# EasyEDA Pro project ProPrj_Avaota A1 八核 AIoT 开发板_2024-05-03.epro, board PCB7 (continued)
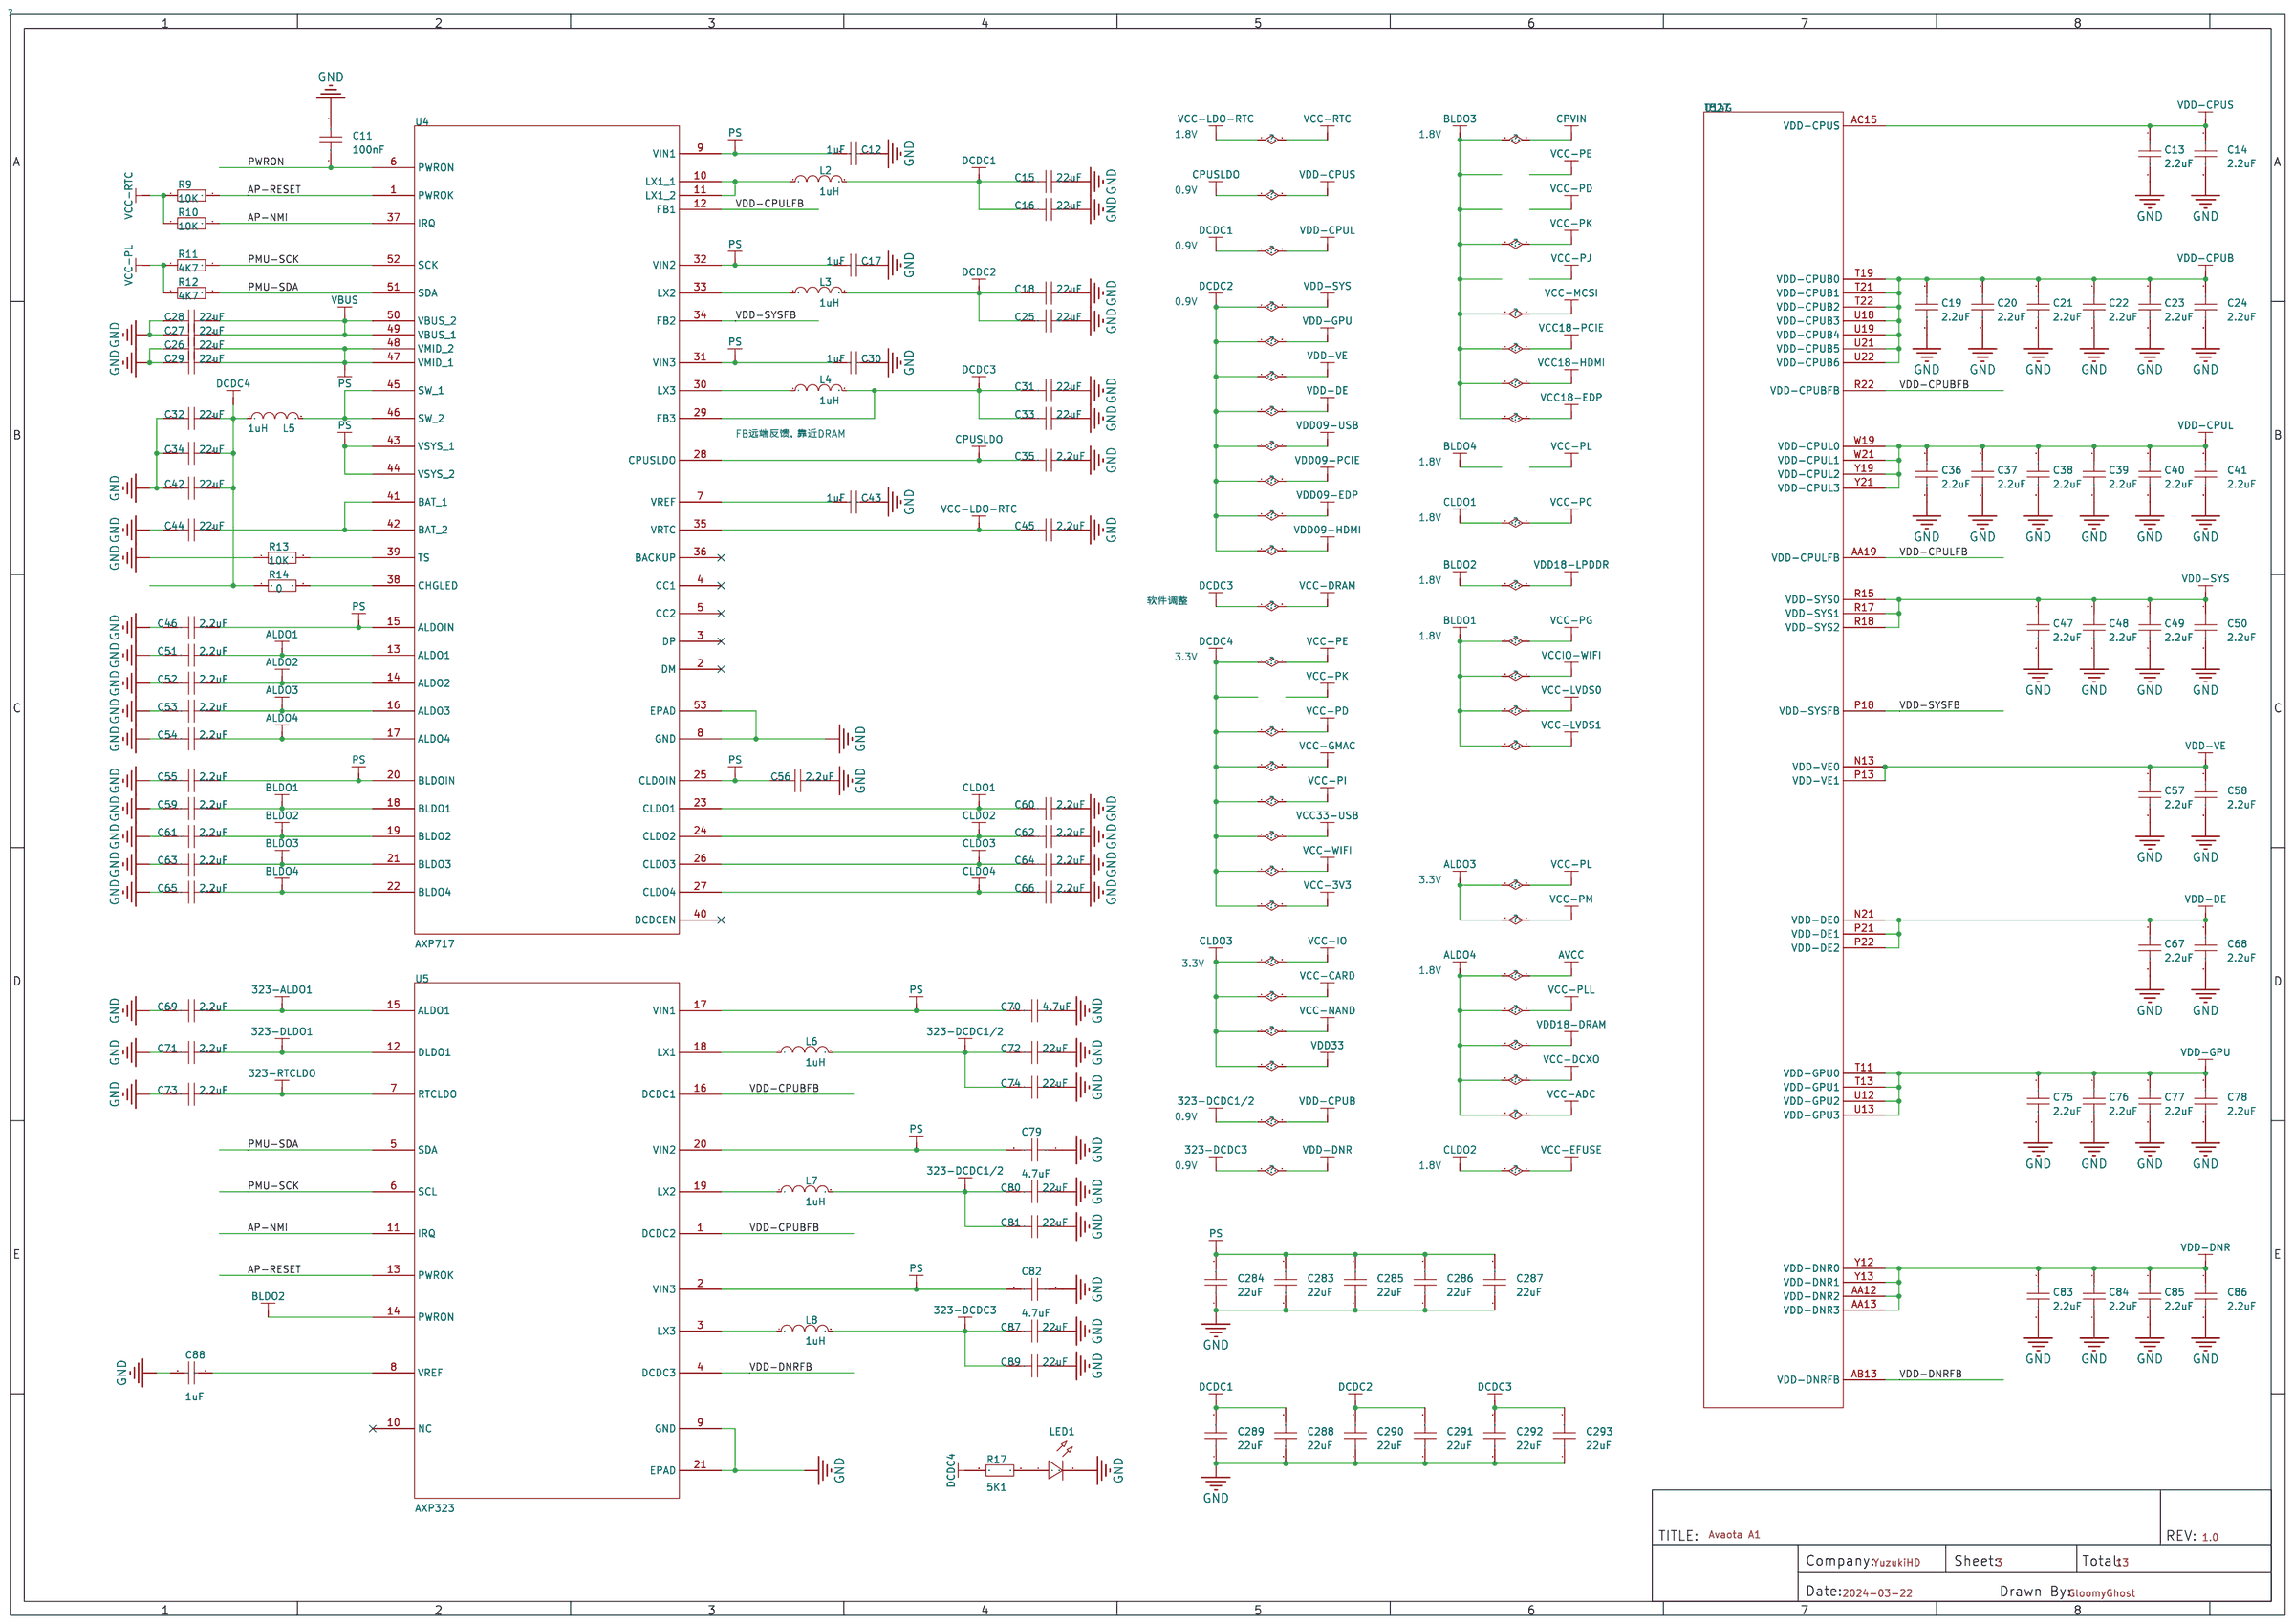
[diagram p0: POWER]
## Routing (per net, layer and track width the routed paths; a pad name or vN(x,y) marks a point on that pad's centre or on a via; arc(x,y) is an arc through that point) (continued)
  Inner1 w0.076: 37.95,17.58 37.9,17.58 37.88,17.55 37.62,17.55 37.59,17.58 37.49,17.58 ; 38.3,9.14 38.35,9.19 38.66,9.19 38.71,9.14
  Bottom Layer w0.203: v1(32.9,11.36) 32.8,11.45 C15.1 ; v1(39.3,12.14) 39.03,11.87 C16.1
  Bottom Layer w0.254: C26.1 35.31,16.14 v1(35.31,16.05) ; v1(30.4,8.47) 30.55,8.32 30.55,7.95 ; 21.31,16.16 21.47,16 C46.2 ; 21.31,16.16 21.31,15.95 20.57,15.95 20.55,15.92 ; 21.31,16.16 21.31,16.28 v1(21.03,16.56) ; 33.09,9.47 33.09,9.01 v1(32.92,8.84) ; 29.92,16.59 30.39,16.59 v1(30.55,16.75) 30.82,17.02 31.52,17.02 31.92,16.62 C43.1 ; C23.1 30.72,15.95 v1(30.28,15.95) 29.9,15.57 29.79,15.57 ; v1(12.67,16.64) 12.62,16.59 12.62,16.36 12.84,16.14 C10.1 ; v1(15.21,17.37) 15.21,17.06 C17.2 15.15,16.99 14.78,16.99 14.71,16.92 C9.1 C11.1 ; v1(32.68,19.95) 32.59,20.04 32.59,20.5 32.61,20.52 ; v1(32.28,5.23) 32.56,5.51 33.61,5.51 ; v1(38.61,17.86) 38.48,17.98 37.8,17.98 37.54,17.73 37.03,17.73 ; v1(40.14,18.52) 39.83,18.82 39.83,19.13 ; v1(32.92,13.94) 33.25,14.27 33.25,14.33 ; C21.1 37.71,15.79 v1(37.8,15.88) ; v1(34.67,15.47) 34.77,15.57 35.13,15.57 ; C42.1 38.01,5.52 v1(37.87,5.38) ; 34.9,10.45 34.46,10.01 v1(34.46,9.91) ; v1(36.9,9.36) 37.04,9.23 37.04,8.81 ; v1(37.77,13.94) 37.52,13.94 37.11,13.53 37.06,13.53 ; C41.1 32.75,18.28 v1(32.94,18.47) ; v1(36.65,5.41) 36.63,5.41 36.53,5.31 36.53,4.78 ; v1(39.31,15.32) 38.94,15.69 38.94,15.7
  vias: v1(40.36,11.12)
VCC-DRAM: length 75.8
  Top Layer w0.115: 28.51,9.78 28.51,9.9 28.5,9.91
  Top Layer w0.203: 30.92,14.94 30.85,15.01 30.28,15.01 29.51,15.77 29.51,16.29
  Top Layer w0.254: v1(38.5,18.53) 38.49,18.53 38.18,18.84 38.12,18.84 ; 34.12,7.79 34.12,7.86 v1(34.59,8.33) ; 32.52,13.64 32.28,13.64 v1(32.13,13.79) ; 36.52,16.24 36.16,16.24 v1(35.97,16.05) ; 34.12,6.49 34.12,6.43 34.42,6.12 35.03,6.12 35.28,6.38 v1(35.28,6.81) 35.56,6.53 v1(36.07,6.53) 36.1,6.49 36.52,6.49 ; v1(35,9.88) 35,9.86 34.65,9.5 34.53,9.5 34.12,9.09 ; 40.11,13.93 v1(40.06,13.87) 39.94,13.87 39.72,13.64 ; 40.11,13.93 40.46,14.27 C34.2 C36.2 ; 40.11,13.93 v1(40.11,14.65) ; v1(33.73,17.88) 33.78,17.88 34.12,17.54 ; 32.52,11.69 32.41,11.69 v1(32.12,11.4) ; v1(35.97,18.92) 36.05,18.84 36.52,18.84 ; 36.52,17.54 36.03,17.54 v1(35.94,17.63) ; 36.52,14.94 36.2,14.94 v1(36.05,15.09) ; C28.1 40.89,10.85 v1(40.87,10.87) ; 38.12,11.69 38.26,11.84 v1(38.26,12.23) ; v1(32.13,9.4) 32.21,9.4 32.52,9.09 ; 30.92,13.64 30.55,13.64 30.48,13.72 ; 34.12,18.84 34.12,18.89 v1(33.76,19.25) ; v1(37.64,13.16) 38.12,13.63 38.12,13.64 ; v1(29.92,7.39) 29.92,7.49 30.23,7.79 30.92,7.79 ; C38.2 C39.2 40.61,6.32 40.26,6.67 40.26,7.39 v1(40.16,7.49) 39.86,7.79 39.72,7.79 ; v1(35.53,9.88) 35.53,10.14 35.28,10.39 34.12,10.39 ; 34.12,14.94 33.8,15.27 33.76,15.27 33.76,15.27 v1(33.75,15.27) ; v1(33.26,19.95) 33.27,19.93 33.27,19.84 33.29,19.82 33.29,19.52 33.32,19.49 ; v1(40.11,14.65) 40.13,14.67 ; v1(40.11,14.65) 40.01,14.65 39.72,14.94 ; v1(36.02,7.42) 36.14,7.42 36.52,7.79 ; v1(31.65,5.26) 32.11,5.72 32.11,5.94 32.52,6.36 32.52,6.49 ; 36.52,9.09 36.07,9.54 v1(36.07,9.93) 36.07,9.93 36.52,10.38 36.52,10.39 ; 29.51,16.29 29.16,16.29 v1(28.93,16.05) ; R2.2 28.45,9.79 28.45,9.98 28.72,10.26 29.38,10.26 v1(29.46,10.34) 29.52,10.39 30.92,10.39 ; 32.52,16.24 32.81,16.54 32.94,16.54 32.94,16.49 ; v1(39.39,10.72) 39.72,10.39 ; 37.32,5.84 37.32,5.4 v1(37.28,5.35) ; 38.12,9.09 38.31,9.09 v1(38.55,8.85) ; 30.92,11.69 30.62,11.69 v1(30.56,11.63) ; 39.72,17.54 39.9,17.54 v1(40.16,17.81) 40.79,17.81 C33.2 C31.2 ; C37.2 C35.2 40.11,11.94 v1(39.98,12.07) 39.72,11.8 39.72,11.69 ; v1(34.7,5.21) 34.62,5.28 33.88,5.28 33.32,5.84 ; 38.12,6.49 37.72,6.1 v1(37.72,6.1) ; 34.12,16.24 34.31,16.05 v1(34.62,16.05) ; v1(38.46,15.93) 38.14,16.24 38.12,16.24 ; 30.92,17.54 30.59,17.54 v1(30.53,17.6) ; 37.32,19.49 37.32,19.89 v1(37.44,20.02) 38,20.57 40.59,20.57 C30.2 ; v1(32.13,19.23) 32.13,19.23 32.52,18.84
  Bottom Layer w0.152: v1(13.69,15.15) 13.69,16.7 R3.2
  Bottom Layer w0.203: v1(38.26,12.23) 38.46,12.04 C16.2 ; C14.2 31.7,5.31 v1(31.65,5.26) ; C15.2 32.23,11.51 v1(32.12,11.4) ; v1(35,9.88) v1(35.53,9.88)
  Bottom Layer w0.254: 33.11,20.52 33.11,20.09 v1(33.26,19.95) ; v1(14.69,11.65) v1(14.69,12.15) ; v1(14.69,12.15) 14.61,12.07 C6.2 ; v1(14.69,12.15) v1(14.69,12.65) ; 29.92,17.09 30.17,17.09 30.53,17.45 v1(30.53,17.6) ; 36.53,17.73 36.04,17.73 v1(35.94,17.63) ; 37.03,4.78 37.28,5.02 v1(37.28,5.35) ; v1(40.87,10.87) 40.72,10.72 v1(39.39,10.72) ; C10.2 13.18,15.16 v1(13.19,15.15) ; 38.94,16.2 38.81,16.2 38.53,15.93 v1(38.46,15.93) ; v1(38.55,8.85) 38.51,8.81 37.54,8.81 ; 36.7,18.84 36.05,18.84 v1(35.97,18.92) ; v1(12.69,15.15) v1(12.69,15.65) ; v1(12.69,15.15) v1(13.19,15.15) ; v1(12.69,15.15) v1(12.69,14.65) ; C42.2 v1(37.72,6.1) ; v1(36.07,6.53) 36.07,7.37 v1(36.02,7.42) ; v1(14.69,14.15) 14.69,14.62 ; 14.69,14.62 C40.2 ; 14.69,14.62 v1(14.69,15.15) ; v1(14.69,12.65) 14.64,12.6 C7.2 ; v1(14.69,12.65) v1(14.69,13.15) 14.68,13.16 C8.2 ; v1(13.19,15.15) v1(13.69,15.15) v1(14.19,15.15) ; 29.29,15.57 29.29,15.69 v1(28.93,16.05) ; v1(37.64,13.16) 37.18,13.16 37.06,13.03 ; C43.2 32.92,16.51 v1(32.95,16.49) ; v1(36.07,9.93) 35.55,10.45 35.4,10.45 35.4,10.01 v1(35.53,9.88) ; v1(33.76,19.25) 33.86,19.35 33.86,19.84 ; v1(14.19,15.15) v1(14.69,15.15) ; v1(14.19,15.15) 14.19,15.55 C11.2 ; v1(14.69,15.15) 14.69,15.55 C9.2 ; v1(36.05,15.09) 35.63,15.51 35.63,15.72 v1(35.97,16.05) ; C41.2 v1(33.73,17.88) ; v1(29.92,7.39) 29.96,7.43 C27.1 ; 39.33,19.13 38.74,18.54 38.51,18.54 v1(38.5,18.53) ; 34.11,5.51 34.39,5.51 v1(34.7,5.21)
  vias: v1(30.48,13.72)
VDD18-DRAM: length 7.5
  Top Layer w0.254: 15.19,16.15 U1.AD25
  Bottom Layer w0.254: 20.55,15.42 21.51,15.42 C46.1 ; 20.55,15.42 20.57,15.45 ; 20.55,15.42 19.53,15.42 19.38,15.57 16.43,15.57 15.84,16.15 v1(15.19,16.15) C17.1
VDD18-LPDDR: length 24.9
  Top Layer w0.102: 37.32,9.74 v1(37.67,10.09)
  Top Layer w0.254: 39.72,9.09 v1(40.03,9.4) 40.05,9.4 40.75,8.7 C19.1 C20.2 ; 37.32,15.59 37.09,15.82 36.91,15.82 36.9,15.83 v1(36.89,15.83) ; v1(31.32,16.59) 30.97,16.24 30.92,16.24 ; v1(33.73,9.47) 33.59,9.47 33.32,9.74 ; 33.32,15.59 33.32,15.62 33.72,16.02 v1(33.75,16.02) ; 39.72,16.24 v1(40.26,16.24) 40.42,16.08 C24.2
  Top Layer w0.305: 30.92,9.09 31.25,9.42 31.29,9.42 v1(31.29,9.43)
  Bottom Layer w0.203: v1(33.75,16.02) 33.27,15.55 C25.2 32,14.86 31.32,15.54 C23.2
  Bottom Layer w0.254: C26.2 33.83,16.02 v1(33.75,16.02) ; v1(36.89,15.83) 37.13,15.59 C21.2 ; v1(40.26,16.24) 40.3,16.24 ; C23.2 v1(31.32,16.59) ; v1(31.29,9.43) 31.29,9.96 31.57,10.24 32.33,10.24 32.72,10.62 33.22,10.62 33.5,10.34 33.5,9.71 v1(33.73,9.47) 36.32,9.47 36.5,9.65 36.5,10.24 36.73,10.46 37.29,10.46 v1(37.67,10.09) 37.67,10.09 38.1,10.52 38.73,10.52 38.94,10.31 38.94,9.86 39.34,9.45 39.98,9.45 v1(40.03,9.4)
SAA0: length 16.5
  Top Layer w0.076: v1(18.26,18.67) 18.26,18.72 17.94,19.04 17.94,19.4 U1.AJ33
  Top Layer w0.115: 31.72,14.94 31.42,14.64 30.64,14.64 30.53,14.76 29.8,14.76 28.86,15.7 28.7,15.7 v1(28.35,16.05)
  Inner5 w0.115: v1(18.26,18.67) 18.33,18.75 20.7,18.75 21.69,17.75 25.86,17.75 26.64,16.97 26.93,16.97 27.84,16.05 v1(28.35,16.05)
SAA1: length 17.3
  Top Layer w0.076: U1.AJ32 17.69,19.04 17.94,18.79 17.94,18.36 v1(18.16,18.14)
  Top Layer w0.115: v1(28.73,15.32) 28.73,14.99 29.79,13.92 30.15,13.92 30.37,14.14 30.67,14.14 30.82,14 31.05,14 31.35,14.29 31.72,14.29
  Inner5 w0.115: v1(28.73,15.32) 28.72,15.32 28.56,15.47 27.9,15.47 26.77,16.6 26.49,16.6 25.74,17.35 21.7,17.35 21.41,17.65 20.79,17.65 19.97,18.47 18.53,18.47 18.2,18.14 v1(18.16,18.14)
SAA2: length 23.6
  Top Layer w0.102: v1(36.96,14.61) 36.96,14.61 37.29,14.94 37.32,14.94
  Top Layer w0.115: U1.AG30 16.69,18.11 v1(17.14,17.65)
  Inner5 w0.076: 19.08,17.86 19.02,17.81 18.01,17.81 17.83,17.98 17.53,17.98 17.2,17.65 v1(17.14,17.65)
  Inner5 w0.115: 19.08,17.86 19.25,17.86 20.22,16.89 20.78,16.89 20.86,16.97 21.13,16.97 21.51,16.59 25.46,16.59 26.19,15.86 26.47,15.86 27.58,14.75 28.25,14.74 28.46,14.53 29.04,14.53 29.57,15.05 32.45,15.05 32.61,14.88 34,14.88 34.11,14.77 34.11,14.55 34.49,14.17 35,14.17 35.51,14.68 36.89,14.68 v1(36.96,14.61)
SAA3: length 26.4
  Top Layer w0.115: U1.AG29 16.69,17.6 17.14,17.15 v1(17.14,17.12) ; v1(37.8,14.62) 38.12,14.94
  Inner2 w0.076: 19.25,16.97 19.05,16.76 17.42,16.76 17.14,17.04 v1(17.14,17.12)
  Inner2 w0.115: v1(37.8,14.62) 37.4,15.01 36.73,15.01 36.4,14.68 36.4,13.54 36.27,13.41 35.26,13.41 35.15,13.51 35.15,14.66 34.72,15.09 34.49,15.09 33.96,15.62 32.56,15.62 32.36,15.42 31.65,15.42 30.73,16.33 30.43,16.33 29.54,17.22 29.16,17.22 28.94,17.44 20.82,17.44 20.65,17.6 19.89,17.6 19.25,16.97
SAA4: length 24.9
  Top Layer w0.102: v1(38.53,14.53) 38.53,14.56 38.92,14.94
  Top Layer w0.115: v1(17.69,17.64) U1.AJ30
  Inner5 w0.076: v1(17.69,17.64) 17.73,17.6 19.14,17.6
  Inner5 w0.115: 19.14,17.6 20.18,16.56 20.52,16.56 20.88,16.21 25.32,16.21 26.03,15.49 26.31,15.49 27.43,14.38 28.09,14.38 28.31,14.16 29.2,14.16 29.72,14.68 31.29,14.68 31.45,14.53 32.99,14.53 33.55,13.97 33.93,13.97 34.24,13.67 34.24,13.54 34.37,13.41 37.08,13.41 37.24,13.56 38.02,13.56 38.53,14.07 v1(38.53,14.53)
SAA5: length 29.5
  Top Layer w0.115: U1.AJ31 17.2,18.16 v1(17.2,18.16) ; 38.92,14.29 38.92,14.28 38.56,13.92 38.56,13.44 v1(38.4,13.28)
  Inner5 w0.115: v1(17.2,18.16) 17.12,18.16 16.79,17.83 16.79,16.99 17.3,16.48 18.82,16.48 19.08,16.23 19.08,15.65 20.42,14.3 20.65,14.3 21.03,13.92 25.1,13.92 25.52,13.5 26.16,13.5 27.73,11.93 29.65,11.93 30.45,11.12 31.37,11.12 31.78,10.72 31.78,10.67 32.08,10.36 32.54,10.36 32.72,10.54 33.25,10.54 33.45,10.34 33.96,10.34 34.24,10.62 35.97,10.62 37.9,12.55 37.9,12.78 v1(38.4,13.28)
SAB0: length 23.2
  Top Layer w0.115: v1(31.32,10.69) 31.62,10.39 31.72,10.39 ; 17.65,15.69 U1.AJ25 17.65,15.69 ; 17.65,15.69 v1(17.65,16.11)
  Inner2 w0.076: 19.13,16.59 18.01,16.59 17.65,16.23 v1(17.65,16.11)
  Inner2 w0.115: 19.13,16.59 19.53,16.59 19.66,16.71 20.29,16.71 20.7,17.12 21.46,17.12 21.57,17.01 21.57,16.87 21.68,16.75 21.84,16.75 21.95,16.87 21.95,17.01 22.07,17.12 22.22,17.12 22.33,17.01 22.33,16.87 22.45,16.75 22.6,16.75 22.71,16.87 22.71,17.01 22.83,17.12 22.98,17.12 23.09,17.01 23.09,16.87 23.21,16.75 23.36,16.75 23.48,16.87 23.48,17.01 23.59,17.12 23.74,17.12 23.86,17.01 23.86,16.87 23.97,16.75 24.12,16.75 24.24,16.87 24.24,17.01 24.35,17.12 25.04,17.12 25.15,17.01 25.15,16.52 25.26,16.41 25.42,16.41 25.53,16.52 25.53,17.01 25.64,17.12 25.8,17.12 25.91,17.01 25.91,16.52 26.03,16.41 26.18,16.41 26.29,16.52 26.29,17.01 26.41,17.12 26.56,17.12 26.87,16.8 26.87,16.19 27.9,15.16 28.19,15.16 30.94,12.42 30.94,11.07 v1(31.32,10.69)
SAB1: length 22.6
  Top Layer w0.115: v1(17.12,16.11) 17.12,15.72 U1.AH25 ; v1(29.41,11.5) 29.42,11.51 29.77,11.51 30.11,11.17 30.63,11.17 30.81,11.35 31.06,11.35 31.27,11.15 31.61,11.15 31.72,11.04
  Inner2 w0.115: v1(17.12,16.11) 17.48,15.75 20.55,15.75 21.06,15.24 21.98,15.24 22.1,15.35 22.1,15.7 22.21,15.81 22.37,15.81 22.48,15.7 22.48,15.35 22.59,15.24 22.75,15.24 22.86,15.35 22.86,15.7 22.98,15.81 23.13,15.81 23.24,15.7 23.24,15.35 23.36,15.24 23.51,15.24 23.62,15.35 23.62,15.7 23.74,15.81 23.89,15.81 24,15.7 24,15.35 24.12,15.24 26.16,15.24 27.34,14.06 27.74,14.06 28.8,13 28.8,12.82 28.24,12.27 28.24,12.09 28.47,11.86 28.85,11.86 29.01,12.02 29.01,12.4 29.12,12.51 29.28,12.51 29.41,12.38 v1(29.41,11.5)
SAB2: length 23.3
  Top Layer w0.102: v1(36.93,10.01) 37.32,10.39
  Top Layer w0.115: U1.AL25 v1(18.69,16.11)
  Inner2 w0.115: v1(18.69,16.11) 18.8,16 20.68,16 20.87,15.81 21.65,15.81 21.92,16.08 24.08,16.08 24.46,15.7 26.23,15.7 27.5,14.43 27.89,14.43 29.79,12.52 29.79,11.11 30.98,9.93 32.66,9.93 32.77,9.83 33.88,9.83 34.42,10.36 36.58,10.36 v1(36.93,10.01)
SAB3: length 25.3
  Top Layer w0.115: U1.AK25 18.16,15.68 v1(18.16,16.11) ; 38.12,10.39 37.79,10.72 35.97,10.72 v1(35.33,11.35)
  Inner2 w0.076: v1(18.16,16.11) 18.24,16.11 18.56,16.43 19,16.43 19.18,16.26 19.69,16.26
  Inner2 w0.115: 19.69,16.26 19.79,16.36 20.7,16.36 20.88,16.18 21.39,16.18 21.67,16.46 24.21,16.46 24.59,16.08 26.47,16.08 27.75,14.8 28.04,14.8 30.17,12.66 30.17,11.3 31.17,10.31 32.44,10.31 32.79,10.67 33.12,10.67 33.48,10.31 33.91,10.31 34.34,10.74 34.72,10.74 v1(35.33,11.35)
SAB4: length 26
  Top Layer w0.102: 38.92,10.39 38.92,10.59 38.61,10.9 38.61,11.12 38.38,11.35 37.93,11.35 37.69,11.59 37.69,12.42 37.49,12.62 v1(37.49,12.65)
  Top Layer w0.115: v1(17.65,17.09) 17.69,17.06 U1.AJ27
  Inner5 w0.076: v1(17.65,17.09) 17.97,17.41 18.99,17.41 19.05,17.35
  Inner5 w0.115: v1(37.49,12.65) 37.11,13.03 33.25,13.03 32.54,13.74 32.54,14.02 32.38,14.18 30.38,14.18 30,13.79 28.16,13.79 27.94,14.01 27.28,14.01 26.16,15.13 25.88,15.13 25.18,15.82 20.83,15.82 20.4,16.26 20.12,16.26 19.05,17.32 19.05,17.35
SAB5: length 27
  Top Layer w0.102: v1(38.79,12.83) 38.63,12.67 38.63,11.4 38.92,11.12 38.92,11.04
  Top Layer w0.115: U1.AL29 v1(18.69,18.13)
  Inner5 w0.115: v1(18.69,18.13) 20,18.13 20.82,17.31 21.22,17.31 21.56,16.97 25.6,16.97 26.34,16.23 26.62,16.23 27.74,15.11 28.4,15.11 28.6,14.91 28.88,14.91 29.44,15.47 32.46,15.47 32.62,15.63 33.95,15.63 34.49,15.09 34.85,15.09 35.23,15.47 36.58,15.47 37.08,14.96 38.25,14.96 38.28,14.94 38.71,14.94 38.94,14.71 38.94,12.98 v1(38.79,12.83)
SCKE0-A: length 22
  Top Layer w0.076: U1.AM31 19.34,18.65 19.59,18.9 19.86,18.9 20.18,19.21
  Top Layer w0.115: v1(27.37,17.03) 26.96,17.03 24.78,19.21 20.18,19.21 ; v1(34.62,13.79) 34.47,13.94 33.43,13.94 33.32,14.06 33.32,14.29
  Inner2 w0.115: v1(34.62,13.79) 34.62,13.16 33.86,12.4 31.7,12.4 30.96,13.13 30.96,14.25 30.4,14.81 29.75,14.81 28.88,15.68 28.2,15.68 27.37,16.51 v1(27.37,17.03)
SCKE0-B: length 21.4
  Top Layer w0.076: 20.64,16.65 20.88,16.89 21.74,16.89
  Top Layer w0.097: U1.AN27 20.64,16.65
  Top Layer w0.115: v1(28.02,12.67) 28.09,12.67 28.91,11.86 28.91,11.65 28.74,11.48 28.55,11.48 27.25,12.78 26.67,12.78 26.24,13.21 26.24,14.5 23.98,16.76 21.87,16.76 21.74,16.89 ; v1(33.73,11.35) 33.42,11.04 33.32,11.04
  Inner5 w0.115: v1(33.73,11.35) 33.9,11.35 34.06,11.52 34.06,11.76 33.93,11.89 32.72,11.89 32.08,12.52 30.1,12.52 29.95,12.67 v1(28.02,12.67)
SCKE1-A: length 22.4
  Top Layer w0.076: U1.AL31 18.94,18.9 19.29,18.9 19.44,19.05 19.44,19.29 19.55,19.4 19.79,19.4 20.19,19.8
  Top Layer w0.102: 34.12,14.29 34.13,14.29 34.14,14.3 34.34,14.3 v1(34.62,14.58)
  Top Layer w0.115: 20.19,19.8 20.26,19.8 20.28,19.81 25.02,19.81 27.13,17.7 27.75,17.7 28.11,17.35 28.11,16.9 28.41,16.6 28.81,16.6 v1(29.03,16.81)
  Inner2 w0.115: v1(34.62,14.58) 34.37,14.58 34.09,14.86 33.53,14.86 33.35,14.68 33.35,13.67 33.1,13.41 32.72,13.41 32.51,13.61 32.51,14.5 32.21,14.81 31.7,14.81 30.96,15.54 30.12,15.54 29.9,15.77 29.9,16.33 29.43,16.8 29.03,16.8 v1(29.03,16.81)
SCKE1-B: length 21.8
  Top Layer w0.076: 21.57,17.07 20.8,17.07 20.55,16.81 19.99,16.81 19.9,16.9 19.44,16.9 U1.AM27
  Top Layer w0.115: 21.57,17.07 21.6,17.09 24.03,17.09 26.51,14.62 26.51,13.4 26.8,13.11 27.25,13.11 v1(27.42,13.27) ; v1(34.49,11.38) 34.16,11.04 34.12,11.04
  Inner5 w0.115: v1(34.49,11.38) 34.82,11.38 35.31,11.86 35.31,12.17 35.2,12.27 35.01,12.27 34.89,12.15 34.89,11.87 34.78,11.76 34.55,11.76 34.43,11.87 34.43,12.15 34.32,12.27 32.89,12.27 32.26,12.9 30.24,12.9 30.09,13.06 27.79,13.06 27.57,13.27 v1(27.42,13.27)
SCKN-A: length 21.6
  Top Layer w0.076: 37.05,13.34 37.05,13.36 37.02,13.39 37.02,14.21 37.1,14.29 37.32,14.29 ; 20.78,18.36 20.65,18.24 20.55,18.24 20.42,18.36 20.32,18.36 20.15,18.2 19.74,18.2 U1.AN30
  Top Layer w0.127: 37.05,13.34 37.05,13.06 36.82,12.83 29.71,12.83 27.74,14.81 27.74,15.11 24.48,18.36 20.78,18.36
SCKN-B: length 21.2
  Top Layer w0.076: 36.35,12.41 36.36,12.41 36.39,12.39 36.45,12.39 36.47,12.36 36.54,12.36 37.06,11.84 37.06,11.3 37.32,11.04 ; U1.AN29 19.79,17.65 19.94,17.8 20.67,17.8 20.8,17.67 20.82,17.67 20.82,17.66 21.17,17.66 21.44,17.93 22.39,17.93 22.41,17.91 22.58,17.91
  Top Layer w0.127: 36.35,12.41 29.5,12.41 27.23,14.69 27.23,14.94 24.26,17.91 22.58,17.91
SCKP-A: length 21.6
  Top Layer w0.076: 20.78,18.62 20.27,18.62 20.05,18.4 19.44,18.4 U1.AM30 ; 36.79,13.34 36.79,13.36 36.82,13.39 36.82,13.99 36.52,14.29
  Top Layer w0.127: 20.78,18.62 24.59,18.62 27.99,15.21 27.99,14.91 29.82,13.09 36.72,13.09 36.79,13.16 36.79,13.34
SCKP-B: length 21.9
  Top Layer w0.076: 36.35,12.16 36.45,12.16 36.86,11.76 36.86,11.12 36.78,11.04 36.52,11.04 ; U1.AM28 19.44,17.4 19.86,17.4 20.06,17.59 20.58,17.59 20.71,17.46 20.73,17.46 20.73,17.46 21.25,17.46 21.52,17.73 21.63,17.73 21.71,17.65 21.71,17.58 21.78,17.5 21.93,17.5 22.01,17.58 22.01,17.65 22.09,17.73 22.3,17.73 22.38,17.65 22.58,17.65
  Top Layer w0.127: 22.58,17.65 24.16,17.65 26.97,14.83 26.97,14.58 29.39,12.16 36.35,12.16
SCS0-A: length 21
  Top Layer w0.076: 20.34,19.51 20.19,19.51 19.83,19.15 U1.AN32
  Top Layer w0.115: 20.34,19.51 24.89,19.51 27,17.4 27.53,17.4 27.74,17.2 27.74,16.71 v1(27.89,16.56) ; v1(33.73,14.5) 33.73,14.58 33.37,14.94 33.32,14.94
  Inner2 w0.115: v1(33.73,14.5) 34.11,14.12 34.11,13.16 33.73,12.78 31.86,12.78 31.75,12.89 31.75,14.12 30.7,15.18 29.97,15.18 29.53,15.62 29.53,16.18 29.27,16.43 28.02,16.43 v1(27.89,16.56)
SCS0-B: length 23.7
  Top Layer w0.115: U1.AK29 18.19,17.62 v1(18.72,17.09) ; v1(33.73,10.69) 33.43,10.39 33.32,10.39
  Inner5 w0.115: v1(18.72,17.09) 18.9,17.09 20.09,15.9 20.35,15.9 20.76,15.48 25,15.48 25.73,14.76 26.01,14.76 27.13,13.64 27.79,13.64 28,13.42 30.24,13.42 30.34,13.33 32.42,13.33 33.1,12.65 35.51,12.65 35.71,12.45 35.71,11.18 35.51,10.97 34.01,10.97 v1(33.73,10.69)
SCS1-A: length 20.7
  Top Layer w0.076: 20.27,21.16 20.12,21.01 20.12,20.66 19.44,19.97 19.44,19.55 19.19,19.3 U1.AM32
  Top Layer w0.115: 20.27,21.16 20.65,21.16 20.85,20.96 20.85,20.4 21.13,20.12 25.22,20.12 27.28,18.06 27.92,18.06 28.47,17.5 28.47,17.07 v1(28.5,17.04) ; v1(32.11,15.88) 32.13,15.85 32.13,15.06 32.25,14.94 32.52,14.94
  Inner5 w0.115: v1(32.11,15.88) 31.7,15.88 31.58,15.99 31.58,16.09 31.47,16.21 31.24,16.21 31.13,16.09 31.13,15.99 31.01,15.88 30.76,15.88 30.68,15.95 30.68,16.22 30.57,16.33 30.4,16.33 30.19,16.55 29.91,16.55 29.79,16.44 29.79,15.94 29.68,15.82 29.45,15.82 29.34,15.94 29.34,16.32 29.22,16.43 28.38,16.43 28.27,16.55 28.27,16.93 28.38,17.04 v1(28.5,17.04)
SCS1-B: length 22.6
  Top Layer w0.102: v1(18.19,17.09) 18.19,17.09 U1.AK27
  Top Layer w0.115: v1(32.21,10.72) 32.21,10.7 32.52,10.39
  Inner5 w0.115: v1(32.21,10.72) 32.36,10.72 32.51,10.87 32.51,11.58 32.05,12.04 30.06,12.04 29.81,12.29 27.89,12.29 26.31,13.87 25.64,13.87 25.48,14.03 25.48,14.48 24.82,15.14 24.71,15.14 24.59,15.02 24.59,14.85 24.48,14.73 24.25,14.73 24.13,14.85 24.13,15.02 24.02,15.14 23.79,15.14 23.68,15.02 23.68,14.81 23.56,14.7 23.33,14.7 23.22,14.81 23.22,15.02 23.11,15.14 22.88,15.14 22.76,15.02 22.76,14.85 22.65,14.73 22.42,14.73 22.3,14.85 22.3,15.02 22.19,15.14 21.96,15.14 21.85,15.02 21.85,14.85 21.73,14.73 21.51,14.73 21.39,14.85 21.39,15.02 21.28,15.14 21.12,15.14 21.01,15.02 21.01,14.83 20.88,14.7 20.72,14.7 20.6,14.83 20.6,15.19 20.4,15.39 19.96,15.39 19.84,15.52 19.84,15.65 19.73,15.75 19.51,15.75 19.41,15.86 19.41,16.21 18.87,16.74 18.08,16.74 17.98,16.84 17.98,17 18.08,17.09 v1(18.19,17.09)
SDQ0: length 21.9
  Top Layer w0.115: v1(16.1,17.09) 15.75,17.09 U1.AE28 ; 33.32,16.89 33.45,16.89 33.76,16.59 v1(33.76,16.56)
  Inner2 w0.115: v1(33.76,16.56) 33.71,16.56 33.43,16.84 32.08,16.84 31.45,17.48 31.11,17.48 30.94,17.65 30.94,18.03 30.26,18.71 22,18.71 21.59,19.11 19.29,19.11 19.04,19.37 16.93,19.37 16.56,19 16.56,17.55 v1(16.1,17.09)
SDQ1: length 21.3
  Top Layer w0.076: v1(16.08,16.58) 16.01,16.65 U1.AE27
  Top Layer w0.115: 33.32,16.24 33.08,16 32.94,16 32.92,15.98 v1(32.91,15.98)
  Inner2 w0.076: 17.25,19.1 17.32,19.18 18.8,19.18 18.87,19.1
  Inner2 w0.115: 18.87,19.1 19.19,18.78 21.45,18.78 21.95,18.29 29.49,18.29 29.71,18.07 29.71,17.68 30.29,17.11 30.89,17.11 30.94,17.06 31.36,17.06 31.95,16.46 32.42,16.46 v1(32.91,15.98) ; 17.25,19.1 16.99,19.1 16.79,18.9 16.79,17.27 16.1,16.58 v1(16.08,16.58)
SDQ2: length 22.3
  Top Layer w0.115: v1(29.31,17.83) 29.23,17.83 28.3,18.77 27.58,18.77 27.36,19 27.36,19.23 27.53,19.41 28.12,19.41 29.31,18.21 29.46,18.21 29.72,17.96 29.72,17.74 29.93,17.53 29.95,17.53 29.98,17.5 30.02,17.5 30.32,17.21 31.41,17.21 31.72,16.89 ; U1.AG32 17.14,18.7
  Inner2 w0.076: v1(17.14,18.69) 17.45,19 18.54,19 18.59,18.95
  Inner2 w0.115: 18.59,18.95 19.13,18.42 19.44,18.42 19.55,18.3 19.55,18.1 19.66,17.98 19.89,17.98 20.01,18.1 20.01,18.3 20.12,18.42 21.18,18.42 21.74,17.86 29.29,17.86 v1(29.31,17.83)
SDQ3: length 21.3
  Top Layer w0.076: U1.AH33 17.45,19.91 18.34,19.91 18.43,20 18.43,20.02 18.54,20.13 18.55,20.13 v1(19.2,20.78)
  Top Layer w0.115: 31.72,16.24 31.45,15.97 30.79,15.97 30.17,16.59 30.17,16.97 30.06,17.08 29.95,17.08 29.73,17.3 29.25,17.3 28.11,18.44 27.38,18.44 27,18.82 27,19.41 27.33,19.74 28.32,19.74 28.45,19.86 28.45,20.14 28.32,20.27 27.79,20.27 27.64,20.42 27.64,20.73 v1(27.69,20.78)
  Inner2 w0.115: v1(27.69,20.78) 27.31,21.15 19.58,21.15 v1(19.2,20.78)
SDQ4: length 18.8
  Top Layer w0.115: U1.AE30 15.23,18.15 v1(15.19,18.11) ; 31.72,18.84 31.39,19.18 30.81,19.18 30.12,19.86 29.44,19.86 v1(29.08,19.5)
  Inner2 w0.115: v1(29.08,19.5) 29.03,19.56 22.63,19.56 22.43,19.76 19.63,19.76 19.56,19.84 16.43,19.84 15.7,19.1 15.7,18.52 15.29,18.11 v1(15.19,18.11)
SDQ5: length 21.1
  Top Layer w0.076: U1.AD32 15.44,19.4 15.44,19.75 15.57,19.89 15.57,20.37 v1(15.99,20.79)
  Top Layer w0.115: 33.32,18.84 33.01,19.15 32.97,19.15 32.95,19.17
  Inner2 w0.115: v1(32.95,19.17) 32.91,19.21 32.71,19.21 29.93,21.99 17.14,21.99 15.99,20.84 v1(15.99,20.79)
SDQ6: length 20.8
  Top Layer w0.115: v1(29.77,19.5) 29.61,19.5 29.23,19.13 29.23,18.64 29.34,18.54 29.46,18.54 29.54,18.62 29.54,19.06 29.62,19.14 29.79,19.14 29.87,19.05 29.87,18.66 29.98,18.54 30.11,18.54 30.23,18.66 30.23,19.05 30.3,19.13 30.45,19.13 30.56,19.02 30.56,18.71 30.73,18.54 31.37,18.54 31.72,18.19 ; U1.AE31 15.73,18.69 v1(16.16,18.69)
  Inner2 w0.115: v1(16.16,18.69) 16.16,19.05 16.71,19.61 19.2,19.61 19.35,19.46 21.84,19.46 22.17,19.13 29.39,19.13 v1(29.77,19.5)
SDQ7: length 23.5
  Top Layer w0.076: v1(15.48,20.79) 15.48,20.49 15.42,20.44 15.42,19.95 15.29,19.82 15.29,19.75 U1.AD33
  Top Layer w0.115: v1(33.68,18.49) 33.38,18.19 33.32,18.19
  Inner2 w0.115: v1(15.48,20.79) 15.48,20.94 16.95,22.41 31.34,22.41 33.63,20.12 33.63,19.79 33.35,19.51 33.35,18.82 v1(33.68,18.49)
SDQ8: length 28.2
  Top Layer w0.115: U1.AC27 14.43,16.91 v1(14.27,16.91) ; v1(35.36,16.92) 35.71,17.27 36.22,17.27 36.27,17.22 36.99,17.22 37.32,16.89
  Inner5 w0.115: v1(14.27,16.91) 14.67,16.91 14.78,17.02 14.78,17.5 15.01,17.73 16.31,17.73 16.61,18.03 16.61,18.9 16.74,19.03 20.77,19.03 21.61,18.19 26.16,18.19 26.87,17.48 28.91,17.48 29.21,17.17 29.46,17.17 29.57,17.28 29.57,17.36 29.69,17.48 29.92,17.48 30.03,17.36 30.03,17.28 30.14,17.17 30.76,17.17 30.94,17.35 31.45,17.35 31.93,16.87 31.93,16.45 32.04,16.33 32.27,16.33 32.39,16.45 32.39,16.73 32.5,16.84 33.27,16.84 33.35,16.92 33.98,16.92 34.44,16.46 34.9,16.46 v1(35.36,16.92)
SDQ9: length 28.1
  Top Layer w0.115: v1(14.31,17.43) 14.41,17.43 U1.AC28 ; v1(34.57,17.86) 34.95,17.48 34.95,16.79 35.18,16.56 36.67,16.56 36.9,16.33 37.23,16.33 37.32,16.24
  Inner5 w0.115: v1(14.31,17.43) 14.31,17.58 14.83,18.11 14.83,18.87 15.44,19.48 21.21,19.48 21.67,19.02 26.34,19.02 26.98,18.38 27.14,18.38 27.38,18.62 27.51,18.62 27.64,18.49 27.64,18.35 27.75,18.24 28.65,18.24 29.06,18.65 30.17,18.65 30.65,19.13 31.2,19.13 31.32,19.01 31.32,18.87 32.13,18.06 32.97,18.06 33.5,17.53 34.45,17.53 34.57,17.64 v1(34.57,17.86)
SDQ10: length 26.9
  Top Layer w0.076: v1(14.23,18.15) 14.69,18.15 U1.AC30
  Top Layer w0.115: v1(35.26,19.23) 35.56,19.53 36.07,19.53 36.42,19.18 36.98,19.18 37.32,18.84
  Inner5 w0.115: v1(14.23,18.15) 14.29,18.15 14.61,18.47 14.61,19.18 15.14,19.71 21.56,19.71 21.83,19.44 26.43,19.44 26.81,19.06 27.86,19.06 27.98,18.95 27.98,18.73 28.09,18.62 28.32,18.62 28.43,18.73 28.43,18.95 28.55,19.06 30,19.06 30.44,19.51 31.58,19.51 31.7,19.39 31.7,19.05 31.88,18.87 32.49,18.87 32.54,18.82 33.43,18.82 33.48,18.87 35.14,18.87 35.26,18.99 v1(35.26,19.23)
SDQ11: length 26.1
  Top Layer w0.115: v1(14.23,18.69) 14.65,18.69 U1.AC31 ; 37.32,18.19 36.97,18.54 35.84,18.54 35.53,18.85 34.98,18.85 v1(34.59,19.23)
  Inner5 w0.115: v1(34.59,19.23) 34.32,19.23 34.2,19.34 34.2,19.47 33.84,19.83 33.68,19.83 33.43,19.58 32.39,19.58 32.11,19.86 28.75,19.86 28.65,19.76 28.65,19.52 28.54,19.41 28.22,19.41 28.04,19.58 27.61,19.58 27.51,19.48 26.99,19.48 26.87,19.6 26.87,19.76 26.77,19.86 21.99,19.86 21.91,19.94 14.99,19.94 14.23,19.18 v1(14.23,18.69)
SDQ12: length 32.7
  Top Layer w0.115: v1(13.62,20.22) 13.69,20.15 U1.AA33 ; 38.92,18.19 39.45,18.72 39.45,19.64 v1(39.83,20.02)
  Inner5 w0.115: v1(13.62,20.22) 13.36,20.22 12.9,20.68 12.9,21.03 13.28,21.41 13.28,21.67 14.03,22.42 37.43,22.42 v1(39.83,20.02)
SDQ13: length 31.5
  Top Layer w0.076: v1(13.3,20.85) 13.39,20.85 13.7,20.54 13.75,20.54 13.94,20.35 13.94,18.9 U1.AA31
  Top Layer w0.115: 38.92,18.84 39.24,19.17 39.24,19.71 v1(38.94,20.02)
  Inner5 w0.115: v1(13.3,20.85) 13.3,21.04 13.59,21.34 13.59,21.56 14.02,22 37.34,22 38.94,20.4 v1(38.94,20.02)
SDQ14: length 32.5
  Top Layer w0.102: U1.AA28 13.24,17.15 v1(13.23,17.14)
  Top Layer w0.115: v1(39.25,16.61) 38.92,16.28 38.92,16.24
  Inner5 w0.115: v1(13.23,17.14) 13.59,17.5 13.59,19.48 14.5,20.4 20.62,20.4 20.93,20.7 27.23,20.7 27.53,20.4 27.84,20.4 28.14,20.7 35.23,20.7 36.93,19 36.93,17.5 37.65,16.78 38.2,16.78 38.28,16.87 38.99,16.87 39.24,16.61 v1(39.25,16.61)
SDQ15: length 31.8
  Top Layer w0.115: v1(13.18,16.61) 13.65,16.61 U1.AA27 ; v1(38.51,16.51) 38.54,16.51 38.92,16.89
  Inner5 w0.115: v1(38.51,16.51) 37.47,16.51 36.53,17.45 36.53,18.87 35.12,20.28 28.32,20.28 28.01,19.98 27.36,19.98 27.05,20.28 21.04,20.28 20.93,20.17 14.71,20.17 13.87,19.33 13.87,17.2 13.28,16.61 v1(13.18,16.61)
